# EAGLE schematic Resistor_Resistor (EAGLE 8.3.0), part 17 of 43
## Parts (continued)
R23018  10K  RESISTOR_0201  [0201]
R23019  10K  RESISTOR_0201  [0201]
R23020  10K  RESISTOR_0201  [0201]
R23021  10K  RESISTOR_0201  [0201]
R23022  10K  RESISTOR_0201  [0201]
R23023  10K  RESISTOR_0201  [0201]
R23024  10K  RESISTOR_0201  [0201]
R23025  10K  RESISTOR_0201  [0201]
R23026  10K  RESISTOR_0201  [0201]
R23027  10K  RESISTOR_0201  [0201]
R23028  10K  RESISTOR_0201  [0201]
R23029  10K  RESISTOR_0201  [0201]
R23030  10K  RESISTOR_0201  [0201]
R23031  10K  RESISTOR_0201  [0201]
R23032  10K  RESISTOR_0201  [0201]
R23033  10K  RESISTOR_0201  [0201]
R23034  10K  RESISTOR_0201  [0201]
R23035  10K  RESISTOR_0201  [0201]
R23036  10K  RESISTOR_0201  [0201]
R23037  10K  RESISTOR_0201  [0201]
R23038  10K  RESISTOR_0201  [0201]
R23039  10K  RESISTOR_0201  [0201]
R23040  10K  RESISTOR_0201  [0201]
R23041  10K  RESISTOR_0201  [0201]
R23042  10K  RESISTOR_0201  [0201]
R23043  10K  RESISTOR_0201  [0201]
R23044  10K  RESISTOR_0201  [0201]
R23045  10K  RESISTOR_0201  [0201]
R23046  10K  RESISTOR_0201  [0201]
R23047  10K  RESISTOR_0201  [0201]
R23048  10K  RESISTOR_0201  [0201]
R23049  10K  RESISTOR_0201  [0201]
R23050  10K  RESISTOR_0201  [0201]
R23051  10K  RESISTOR_0201  [0201]
R23052  10K  RESISTOR_0201  [0201]
R23053  10K  RESISTOR_0201  [0201]
R23054  10K  RESISTOR_0201  [0201]
R23055  10K  RESISTOR_0201  [0201]
R23056  10K  RESISTOR_0201  [0201]
R23057  10K  RESISTOR_0201  [0201]
R23058  10K  RESISTOR_0201  [0201]
R23059  10K  RESISTOR_0201  [0201]
R23060  10K  RESISTOR_0201  [0201]
R23061  10K  RESISTOR_0201  [0201]
R23062  10K  RESISTOR_0201  [0201]
R23063  10K  RESISTOR_0201  [0201]
R23064  10K  RESISTOR_0201  [0201]
R23065  10K  RESISTOR_0201  [0201]
R23066  10K  RESISTOR_0201  [0201]
R23067  10K  RESISTOR_0201  [0201]
R23068  10K  RESISTOR_0201  [0201]
R23069  10K  RESISTOR_0201  [0201]
R23070  10K  RESISTOR_0201  [0201]
R23071  10K  RESISTOR_0201  [0201]
R23072  10K  RESISTOR_0201  [0201]
R23073  10K  RESISTOR_0201  [0201]
R23074  10K  RESISTOR_0201  [0201]
R23075  10K  RESISTOR_0201  [0201]
R23076  10K  RESISTOR_0201  [0201]
R23077  10K  RESISTOR_0201  [0201]
R23078  10K  RESISTOR_0201  [0201]
R23079  10K  RESISTOR_0201  [0201]
R23080  10K  RESISTOR_0201  [0201]
R23081  10K  RESISTOR_0201  [0201]
R23082  10K  RESISTOR_0201  [0201]
R23083  10K  RESISTOR_0201  [0201]
R23084  10K  RESISTOR_0201  [0201]
R23085  10K  RESISTOR_0201  [0201]
R23086  10K  RESISTOR_0201  [0201]
R23087  10K  RESISTOR_0201  [0201]
R23088  10K  RESISTOR_0201  [0201]
R23089  10K  RESISTOR_0201  [0201]
R23090  10K  RESISTOR_0201  [0201]
R23091  10K  RESISTOR_0201  [0201]
R23092  10K  RESISTOR_0201  [0201]
R23093  10K  RESISTOR_0201  [0201]
R23094  10K  RESISTOR_0201  [0201]
R23095  10K  RESISTOR_0201  [0201]
R23096  10K  RESISTOR_0201  [0201]
R23097  10K  RESISTOR_0201  [0201]
R23098  10K  RESISTOR_0201  [0201]
R23099  10K  RESISTOR_0201  [0201]
R23100  10K  RESISTOR_0201  [0201]
R23101  10K  RESISTOR_0201  [0201]
R23102  10K  RESISTOR_0201  [0201]
R23103  10K  RESISTOR_0201  [0201]
R23104  10K  RESISTOR_0201  [0201]
R23105  10K  RESISTOR_0201  [0201]
R23106  10K  RESISTOR_0201  [0201]
R23107  10K  RESISTOR_0201  [0201]
R23108  10K  RESISTOR_0201  [0201]
R23109  10K  RESISTOR_0201  [0201]
R23110  10K  RESISTOR_0201  [0201]
R23111  10K  RESISTOR_0201  [0201]
R23112  10K  RESISTOR_0201  [0201]
R23113  10K  RESISTOR_0201  [0201]
R23114  10K  RESISTOR_0201  [0201]
R23115  10K  RESISTOR_0201  [0201]
R23116  10K  RESISTOR_0201  [0201]
R23117  10K  RESISTOR_0201  [0201]
R23118  10K  RESISTOR_0201  [0201]
R23119  10K  RESISTOR_0201  [0201]
R23120  10K  RESISTOR_0201  [0201]
R23121  10K  RESISTOR_0201  [0201]
R23122  10K  RESISTOR_0201  [0201]
R23123  10K  RESISTOR_0201  [0201]
R23124  10K  RESISTOR_0201  [0201]
R23125  10K  RESISTOR_0201  [0201]
R23126  10K  RESISTOR_0201  [0201]
R23127  10K  RESISTOR_0201  [0201]
R23128  10K  RESISTOR_0201  [0201]
R23129  10K  RESISTOR_0201  [0201]
R23130  10K  RESISTOR_0201  [0201]
R23131  10K  RESISTOR_0201  [0201]
R23132  10K  RESISTOR_0201  [0201]
R23133  10K  RESISTOR_0201  [0201]
R23134  10K  RESISTOR_0201  [0201]
R23135  10K  RESISTOR_0201  [0201]
R23136  10K  RESISTOR_0201  [0201]
R23137  10K  RESISTOR_0201  [0201]
R23138  10K  RESISTOR_0201  [0201]
R23139  10K  RESISTOR_0201  [0201]
R23140  10K  RESISTOR_0201  [0201]
R23141  10K  RESISTOR_0201  [0201]
R23142  10K  RESISTOR_0201  [0201]
R23143  10K  RESISTOR_0201  [0201]
R23144  10K  RESISTOR_0201  [0201]
R23145  10K  RESISTOR_0201  [0201]
R23146  10K  RESISTOR_0201  [0201]
R23147  10K  RESISTOR_0201  [0201]
R23148  10K  RESISTOR_0201  [0201]
R23149  10K  RESISTOR_0201  [0201]
R23150  10K  RESISTOR_0201  [0201]
R23151  10K  RESISTOR_0201  [0201]
R23152  10K  RESISTOR_0201  [0201]
R23153  10K  RESISTOR_0201  [0201]
R23154  10K  RESISTOR_0201  [0201]
R23155  10K  RESISTOR_0201  [0201]
R23156  10K  RESISTOR_0201  [0201]
R23157  10K  RESISTOR_0201  [0201]
R23158  10K  RESISTOR_0201  [0201]
R23159  10K  RESISTOR_0201  [0201]
R23160  10K  RESISTOR_0201  [0201]
R23161  10K  RESISTOR_0201  [0201]
R23162  10K  RESISTOR_0201  [0201]
R23163  10K  RESISTOR_0201  [0201]
R23164  10K  RESISTOR_0201  [0201]
R23165  10K  RESISTOR_0201  [0201]
R23166  10K  RESISTOR_0201  [0201]
R23167  10K  RESISTOR_0201  [0201]
R23168  10K  RESISTOR_0201  [0201]
R23169  10K  RESISTOR_0201  [0201]
R23170  10K  RESISTOR_0201  [0201]
R23171  10K  RESISTOR_0201  [0201]
R23172  10K  RESISTOR_0201  [0201]
R23173  10K  RESISTOR_0201  [0201]
R23174  10K  RESISTOR_0201  [0201]
R23175  10K  RESISTOR_0201  [0201]
R23176  10K  RESISTOR_0201  [0201]
R23177  10K  RESISTOR_0201  [0201]
R23178  10K  RESISTOR_0201  [0201]
R23179  10K  RESISTOR_0201  [0201]
R23180  10K  RESISTOR_0201  [0201]
R23181  10K  RESISTOR_0201  [0201]
R23182  10K  RESISTOR_0201  [0201]
R23183  10K  RESISTOR_0201  [0201]
R23184  10K  RESISTOR_0201  [0201]
R23185  10K  RESISTOR_0201  [0201]
R23186  10K  RESISTOR_0201  [0201]
R23187  10K  RESISTOR_0201  [0201]
R23188  10K  RESISTOR_0201  [0201]
R23189  10K  RESISTOR_0201  [0201]
R23190  10K  RESISTOR_0201  [0201]
R23191  10K  RESISTOR_0201  [0201]
R23192  10K  RESISTOR_0201  [0201]
R23193  10K  RESISTOR_0201  [0201]
R23194  10K  RESISTOR_0201  [0201]
R23195  10K  RESISTOR_0201  [0201]
R23196  10K  RESISTOR_0201  [0201]
R23197  10K  RESISTOR_0201  [0201]
R23198  10K  RESISTOR_0201  [0201]
R23199  10K  RESISTOR_0201  [0201]
R23200  10K  RESISTOR_0201  [0201]
R23201  10K  RESISTOR_0201  [0201]
R23202  10K  RESISTOR_0201  [0201]
R23203  10K  RESISTOR_0201  [0201]
R23204  10K  RESISTOR_0201  [0201]
R23205  10K  RESISTOR_0201  [0201]
R23206  10K  RESISTOR_0201  [0201]
R23207  10K  RESISTOR_0201  [0201]
R23208  10K  RESISTOR_0201  [0201]
R23209  10K  RESISTOR_0201  [0201]
R23210  10K  RESISTOR_0201  [0201]
R23211  10K  RESISTOR_0201  [0201]
R23212  10K  RESISTOR_0201  [0201]
R23213  10K  RESISTOR_0201  [0201]
R23214  10K  RESISTOR_0201  [0201]
R23215  10K  RESISTOR_0201  [0201]
R23216  10K  RESISTOR_0201  [0201]
R23217  10K  RESISTOR_0201  [0201]
R23218  10K  RESISTOR_0201  [0201]
R23219  10K  RESISTOR_0201  [0201]
R23220  10K  RESISTOR_0201  [0201]
R23221  10K  RESISTOR_0201  [0201]
R23222  10K  RESISTOR_0201  [0201]
R23223  10K  RESISTOR_0201  [0201]
R23224  10K  RESISTOR_0201  [0201]
R23225  10K  RESISTOR_0201  [0201]
R23226  10K  RESISTOR_0201  [0201]
R23227  10K  RESISTOR_0201  [0201]
R23228  10K  RESISTOR_0201  [0201]
R23229  10K  RESISTOR_0201  [0201]
R23230  10K  RESISTOR_0201  [0201]
R23231  10K  RESISTOR_0201  [0201]
R23232  10K  RESISTOR_0201  [0201]
R23233  10K  RESISTOR_0201  [0201]
R23234  10K  RESISTOR_0201  [0201]
R23235  10K  RESISTOR_0201  [0201]
R23236  10K  RESISTOR_0201  [0201]
R23237  10K  RESISTOR_0201  [0201]
R23238  10K  RESISTOR_0201  [0201]
R23239  10K  RESISTOR_0201  [0201]
R23240  10K  RESISTOR_0201  [0201]
R23241  10K  RESISTOR_0201  [0201]
R23242  10K  RESISTOR_0201  [0201]
R23243  10K  RESISTOR_0201  [0201]
R23244  10K  RESISTOR_0201  [0201]
R23245  10K  RESISTOR_0201  [0201]
R23246  10K  RESISTOR_0201  [0201]
R23247  10K  RESISTOR_0201  [0201]
R23248  10K  RESISTOR_0201  [0201]
R23249  10K  RESISTOR_0201  [0201]
R23250  10K  RESISTOR_0201  [0201]
R23251  10K  RESISTOR_0201  [0201]
R23252  10K  RESISTOR_0201  [0201]
R23253  10K  RESISTOR_0201  [0201]
R23254  10K  RESISTOR_0201  [0201]
R23255  10K  RESISTOR_0201  [0201]
R23256  10K  RESISTOR_0201  [0201]
R23257  10K  RESISTOR_0201  [0201]
R23258  10K  RESISTOR_0201  [0201]
R23259  10K  RESISTOR_0201  [0201]
R23260  10K  RESISTOR_0201  [0201]
R23261  10K  RESISTOR_0201  [0201]
R23262  10K  RESISTOR_0201  [0201]
R23263  10K  RESISTOR_0201  [0201]
R23264  10K  RESISTOR_0201  [0201]
R23265  10K  RESISTOR_0201  [0201]
R23266  10K  RESISTOR_0201  [0201]
R23267  10K  RESISTOR_0201  [0201]
R23268  10K  RESISTOR_0201  [0201]
R23269  10K  RESISTOR_0201  [0201]
R23270  10K  RESISTOR_0201  [0201]
R23271  10K  RESISTOR_0201  [0201]
R23272  10K  RESISTOR_0201  [0201]
R23273  10K  RESISTOR_0201  [0201]
R23274  10K  RESISTOR_0201  [0201]
R23275  10K  RESISTOR_0201  [0201]
R23276  10K  RESISTOR_0201  [0201]
R23277  10K  RESISTOR_0201  [0201]
R23278  10K  RESISTOR_0201  [0201]
R23279  10K  RESISTOR_0201  [0201]
R23280  10K  RESISTOR_0201  [0201]
R23281  10K  RESISTOR_0201  [0201]
R23282  10K  RESISTOR_0201  [0201]
R23283  10K  RESISTOR_0201  [0201]
R23284  10K  RESISTOR_0201  [0201]
R23285  10K  RESISTOR_0201  [0201]
R23286  10K  RESISTOR_0201  [0201]
R23287  10K  RESISTOR_0201  [0201]
R23288  10K  RESISTOR_0201  [0201]
R23289  10K  RESISTOR_0201  [0201]
R23290  10K  RESISTOR_0201  [0201]
R23291  10K  RESISTOR_0201  [0201]
R23292  10K  RESISTOR_0201  [0201]
R23293  10K  RESISTOR_0201  [0201]
R23294  10K  RESISTOR_0201  [0201]
R23295  10K  RESISTOR_0201  [0201]
R23296  10K  RESISTOR_0201  [0201]
R23297  10K  RESISTOR_0201  [0201]
R23298  10K  RESISTOR_0201  [0201]
R23299  10K  RESISTOR_0201  [0201]
R23300  10K  RESISTOR_0201  [0201]
R23301  10K  RESISTOR_0201  [0201]
R23302  10K  RESISTOR_0201  [0201]
R23303  10K  RESISTOR_0201  [0201]
R23304  10K  RESISTOR_0201  [0201]
R23305  10K  RESISTOR_0201  [0201]
R23306  10K  RESISTOR_0201  [0201]
R23307  10K  RESISTOR_0201  [0201]
R23308  10K  RESISTOR_0201  [0201]
R23309  10K  RESISTOR_0201  [0201]
R23310  10K  RESISTOR_0201  [0201]
R23311  10K  RESISTOR_0201  [0201]
R23312  10K  RESISTOR_0201  [0201]
R23313  10K  RESISTOR_0201  [0201]
R23314  10K  RESISTOR_0201  [0201]
R23315  10K  RESISTOR_0201  [0201]
R23316  10K  RESISTOR_0201  [0201]
R23317  10K  RESISTOR_0201  [0201]
R23318  10K  RESISTOR_0201  [0201]
R23319  10K  RESISTOR_0201  [0201]
R23320  10K  RESISTOR_0201  [0201]
R23321  10K  RESISTOR_0201  [0201]
R23322  10K  RESISTOR_0201  [0201]
R23323  10K  RESISTOR_0201  [0201]
R23324  10K  RESISTOR_0201  [0201]
R23325  10K  RESISTOR_0201  [0201]
R23326  10K  RESISTOR_0201  [0201]
R23327  10K  RESISTOR_0201  [0201]
R23328  10K  RESISTOR_0201  [0201]
R23329  10K  RESISTOR_0201  [0201]
R23330  10K  RESISTOR_0201  [0201]
R23331  10K  RESISTOR_0201  [0201]
R23332  10K  RESISTOR_0201  [0201]
R23333  10K  RESISTOR_0201  [0201]
R23334  10K  RESISTOR_0201  [0201]
R23335  10K  RESISTOR_0201  [0201]
R23336  10K  RESISTOR_0201  [0201]
R23337  10K  RESISTOR_0201  [0201]
R23338  10K  RESISTOR_0201  [0201]
R23339  10K  RESISTOR_0201  [0201]
R23340  10K  RESISTOR_0201  [0201]
R23341  10K  RESISTOR_0201  [0201]
R23342  10K  RESISTOR_0201  [0201]
R23343  10K  RESISTOR_0201  [0201]
R23344  10K  RESISTOR_0201  [0201]
R23345  10K  RESISTOR_0201  [0201]
R23346  10K  RESISTOR_0201  [0201]
R23347  10K  RESISTOR_0201  [0201]
R23348  10K  RESISTOR_0201  [0201]
R23349  10K  RESISTOR_0201  [0201]
R23350  10K  RESISTOR_0201  [0201]
R23351  10K  RESISTOR_0201  [0201]
R23352  10K  RESISTOR_0201  [0201]
R23353  10K  RESISTOR_0201  [0201]
R23354  10K  RESISTOR_0201  [0201]
R23355  10K  RESISTOR_0201  [0201]
R23356  10K  RESISTOR_0201  [0201]
R23357  10K  RESISTOR_0201  [0201]
R23358  10K  RESISTOR_0201  [0201]
R23359  10K  RESISTOR_0201  [0201]
R23360  10K  RESISTOR_0201  [0201]
R23361  10K  RESISTOR_0201  [0201]
R23362  10K  RESISTOR_0201  [0201]
R23363  10K  RESISTOR_0201  [0201]
R23364  10K  RESISTOR_0201  [0201]
R23365  10K  RESISTOR_0201  [0201]
R23366  10K  RESISTOR_0201  [0201]
R23367  10K  RESISTOR_0201  [0201]
R23368  10K  RESISTOR_0201  [0201]
R23369  10K  RESISTOR_0201  [0201]
R23370  10K  RESISTOR_0201  [0201]
R23371  10K  RESISTOR_0201  [0201]
R23372  10K  RESISTOR_0201  [0201]
R23373  10K  RESISTOR_0201  [0201]
R23374  10K  RESISTOR_0201  [0201]
R23375  10K  RESISTOR_0201  [0201]
R23376  10K  RESISTOR_0201  [0201]
R23377  10K  RESISTOR_0201  [0201]
R23378  10K  RESISTOR_0201  [0201]
R23379  10K  RESISTOR_0201  [0201]
R23380  10K  RESISTOR_0201  [0201]
R23381  10K  RESISTOR_0201  [0201]
R23382  10K  RESISTOR_0201  [0201]
R23383  10K  RESISTOR_0201  [0201]
R23384  10K  RESISTOR_0201  [0201]
R23385  10K  RESISTOR_0201  [0201]
R23386  10K  RESISTOR_0201  [0201]
R23387  10K  RESISTOR_0201  [0201]
R23388  10K  RESISTOR_0201  [0201]
R23389  10K  RESISTOR_0201  [0201]
R23390  10K  RESISTOR_0201  [0201]
R23391  10K  RESISTOR_0201  [0201]
R23392  10K  RESISTOR_0201  [0201]
R23393  10K  RESISTOR_0201  [0201]
R23394  10K  RESISTOR_0201  [0201]
R23395  10K  RESISTOR_0201  [0201]
R23396  10K  RESISTOR_0201  [0201]
R23397  10K  RESISTOR_0201  [0201]
R23398  10K  RESISTOR_0201  [0201]
R23399  10K  RESISTOR_0201  [0201]
R23400  10K  RESISTOR_0201  [0201]
R23401  10K  RESISTOR_0201  [0201]
R23402  10K  RESISTOR_0201  [0201]
R23403  10K  RESISTOR_0201  [0201]
R23404  10K  RESISTOR_0201  [0201]
R23405  10K  RESISTOR_0201  [0201]
R23406  10K  RESISTOR_0201  [0201]
R23407  10K  RESISTOR_0201  [0201]
R23408  10K  RESISTOR_0201  [0201]
R23409  10K  RESISTOR_0201  [0201]
R23410  10K  RESISTOR_0201  [0201]
R23411  10K  RESISTOR_0201  [0201]
R23412  10K  RESISTOR_0201  [0201]
R23413  10K  RESISTOR_0201  [0201]
R23414  10K  RESISTOR_0201  [0201]
R23415  10K  RESISTOR_0201  [0201]
R23416  10K  RESISTOR_0201  [0201]
R23417  10K  RESISTOR_0201  [0201]
R23418  10K  RESISTOR_0201  [0201]
R23419  10K  RESISTOR_0201  [0201]
R23420  10K  RESISTOR_0201  [0201]
R23421  10K  RESISTOR_0201  [0201]
R23422  10K  RESISTOR_0201  [0201]
R23423  10K  RESISTOR_0201  [0201]
R23424  10K  RESISTOR_0201  [0201]
R23425  10K  RESISTOR_0201  [0201]
R23426  10K  RESISTOR_0201  [0201]
R23427  10K  RESISTOR_0201  [0201]
R23428  10K  RESISTOR_0201  [0201]
R23429  10K  RESISTOR_0201  [0201]
R23430  10K  RESISTOR_0201  [0201]
R23431  10K  RESISTOR_0201  [0201]
R23432  10K  RESISTOR_0201  [0201]
R23433  10K  RESISTOR_0201  [0201]
R23434  10K  RESISTOR_0201  [0201]
R23435  10K  RESISTOR_0201  [0201]
R23436  10K  RESISTOR_0201  [0201]
R23437  10K  RESISTOR_0201  [0201]
R23438  10K  RESISTOR_0201  [0201]
R23439  10K  RESISTOR_0201  [0201]
R23440  10K  RESISTOR_0201  [0201]
R23441  10K  RESISTOR_0201  [0201]
R23442  10K  RESISTOR_0201  [0201]
R23443  10K  RESISTOR_0201  [0201]
R23444  10K  RESISTOR_0201  [0201]
R23445  10K  RESISTOR_0201  [0201]
R23446  10K  RESISTOR_0201  [0201]
R23447  10K  RESISTOR_0201  [0201]
R23448  10K  RESISTOR_0201  [0201]
R23449  10K  RESISTOR_0201  [0201]
R23450  10K  RESISTOR_0201  [0201]
R23451  10K  RESISTOR_0201  [0201]
R23452  10K  RESISTOR_0201  [0201]
R23453  10K  RESISTOR_0201  [0201]
R23454  10K  RESISTOR_0201  [0201]
R23455  10K  RESISTOR_0201  [0201]
R23456  10K  RESISTOR_0201  [0201]
R23457  10K  RESISTOR_0201  [0201]
R23458  10K  RESISTOR_0201  [0201]
R23459  10K  RESISTOR_0201  [0201]
R23460  10K  RESISTOR_0201  [0201]
R23461  10K  RESISTOR_0201  [0201]
R23462  10K  RESISTOR_0201  [0201]
R23463  10K  RESISTOR_0201  [0201]
R23464  10K  RESISTOR_0201  [0201]
R23465  10K  RESISTOR_0201  [0201]
R23466  10K  RESISTOR_0201  [0201]
R23467  10K  RESISTOR_0201  [0201]
R23468  10K  RESISTOR_0201  [0201]
R23469  10K  RESISTOR_0201  [0201]
R23470  10K  RESISTOR_0201  [0201]
R23471  10K  RESISTOR_0201  [0201]
R23472  10K  RESISTOR_0201  [0201]
R23473  10K  RESISTOR_0201  [0201]
R23474  10K  RESISTOR_0201  [0201]
R23475  10K  RESISTOR_0201  [0201]
R23476  10K  RESISTOR_0201  [0201]
R23477  10K  RESISTOR_0201  [0201]
R23478  10K  RESISTOR_0201  [0201]
R23479  10K  RESISTOR_0201  [0201]
R23480  10K  RESISTOR_0201  [0201]
R23481  10K  RESISTOR_0201  [0201]
R23482  10K  RESISTOR_0201  [0201]
R23483  10K  RESISTOR_0201  [0201]
R23484  10K  RESISTOR_0201  [0201]
R23485  10K  RESISTOR_0201  [0201]
R23486  10K  RESISTOR_0201  [0201]
R23487  10K  RESISTOR_0201  [0201]
R23488  10K  RESISTOR_0201  [0201]
R23489  10K  RESISTOR_0201  [0201]
R23490  10K  RESISTOR_0201  [0201]
R23491  10K  RESISTOR_0201  [0201]
R23492  10K  RESISTOR_0201  [0201]
R23493  10K  RESISTOR_0201  [0201]
R23494  10K  RESISTOR_0201  [0201]
R23495  10K  RESISTOR_0201  [0201]
R23496  10K  RESISTOR_0201  [0201]
R23497  10K  RESISTOR_0201  [0201]
R23498  10K  RESISTOR_0201  [0201]
R23499  10K  RESISTOR_0201  [0201]
R23500  10K  RESISTOR_0201  [0201]
R23501  10K  RESISTOR_0201  [0201]
R23502  10K  RESISTOR_0201  [0201]
R23503  10K  RESISTOR_0201  [0201]
R23504  10K  RESISTOR_0201  [0201]
R23505  10K  RESISTOR_0201  [0201]
R23506  10K  RESISTOR_0201  [0201]
R23507  10K  RESISTOR_0201  [0201]
R23508  10K  RESISTOR_0201  [0201]
R23509  10K  RESISTOR_0201  [0201]
R23510  10K  RESISTOR_0201  [0201]
R23511  10K  RESISTOR_0201  [0201]
R23512  10K  RESISTOR_0201  [0201]
R23513  10K  RESISTOR_0201  [0201]
R23514  10K  RESISTOR_0201  [0201]
R23515  10K  RESISTOR_0201  [0201]
R23516  10K  RESISTOR_0201  [0201]
R23517  10K  RESISTOR_0201  [0201]
R23518  10K  RESISTOR_0201  [0201]
R23519  10K  RESISTOR_0201  [0201]
R23520  10K  RESISTOR_0201  [0201]
R23521  10K  RESISTOR_0201  [0201]
R23522  10K  RESISTOR_0201  [0201]
R23523  10K  RESISTOR_0201  [0201]
R23524  10K  RESISTOR_0201  [0201]
R23525  10K  RESISTOR_0201  [0201]
R23526  10K  RESISTOR_0201  [0201]
R23527  10K  RESISTOR_0201  [0201]
R23528  10K  RESISTOR_0201  [0201]
R23529  10K  RESISTOR_0201  [0201]
R23530  10K  RESISTOR_0201  [0201]
R23531  10K  RESISTOR_0201  [0201]
R23532  10K  RESISTOR_0201  [0201]
R23533  10K  RESISTOR_0201  [0201]
R23534  10K  RESISTOR_0201  [0201]
R23535  10K  RESISTOR_0201  [0201]
R23536  10K  RESISTOR_0201  [0201]
R23537  10K  RESISTOR_0201  [0201]
R23538  10K  RESISTOR_0201  [0201]
R23539  10K  RESISTOR_0201  [0201]
R23540  10K  RESISTOR_0201  [0201]
R23541  10K  RESISTOR_0201  [0201]
R23542  10K  RESISTOR_0201  [0201]
R23543  10K  RESISTOR_0201  [0201]
R23544  10K  RESISTOR_0201  [0201]
R23545  10K  RESISTOR_0201  [0201]
R23546  10K  RESISTOR_0201  [0201]
R23547  10K  RESISTOR_0201  [0201]
R23548  10K  RESISTOR_0201  [0201]
R23549  10K  RESISTOR_0201  [0201]
R23550  10K  RESISTOR_0201  [0201]
R23551  10K  RESISTOR_0201  [0201]
R23552  10K  RESISTOR_0201  [0201]
R23553  10K  RESISTOR_0201  [0201]
R23554  10K  RESISTOR_0201  [0201]
R23555  10K  RESISTOR_0201  [0201]
R23556  10K  RESISTOR_0201  [0201]
R23557  10K  RESISTOR_0201  [0201]
R23558  10K  RESISTOR_0201  [0201]
R23559  10K  RESISTOR_0201  [0201]
R23560  10K  RESISTOR_0201  [0201]
R23561  10K  RESISTOR_0201  [0201]
R23562  10K  RESISTOR_0201  [0201]
R23563  10K  RESISTOR_0201  [0201]
R23564  10K  RESISTOR_0201  [0201]
R23565  10K  RESISTOR_0201  [0201]
R23566  10K  RESISTOR_0201  [0201]
R23567  10K  RESISTOR_0201  [0201]
R23568  10K  RESISTOR_0201  [0201]
R23569  10K  RESISTOR_0201  [0201]
R23570  10K  RESISTOR_0201  [0201]
R23571  10K  RESISTOR_0201  [0201]
R23572  10K  RESISTOR_0201  [0201]
R23573  10K  RESISTOR_0201  [0201]
R23574  10K  RESISTOR_0201  [0201]
R23575  10K  RESISTOR_0201  [0201]
R23576  10K  RESISTOR_0201  [0201]
R23577  10K  RESISTOR_0201  [0201]
R23578  10K  RESISTOR_0201  [0201]
R23579  10K  RESISTOR_0201  [0201]
R23580  10K  RESISTOR_0201  [0201]
R23581  10K  RESISTOR_0201  [0201]
R23582  10K  RESISTOR_0201  [0201]
R23583  10K  RESISTOR_0201  [0201]
R23584  10K  RESISTOR_0201  [0201]
R23585  10K  RESISTOR_0201  [0201]
R23586  10K  RESISTOR_0201  [0201]
R23587  10K  RESISTOR_0201  [0201]
R23588  10K  RESISTOR_0201  [0201]
R23589  10K  RESISTOR_0201  [0201]
R23590  10K  RESISTOR_0201  [0201]
R23591  10K  RESISTOR_0201  [0201]
R23592  10K  RESISTOR_0201  [0201]
R23593  10K  RESISTOR_0201  [0201]
R23594  10K  RESISTOR_0201  [0201]
R23595  10K  RESISTOR_0201  [0201]
R23596  10K  RESISTOR_0201  [0201]
R23597  10K  RESISTOR_0201  [0201]
R23598  10K  RESISTOR_0201  [0201]
R23599  10K  RESISTOR_0201  [0201]
R23600  10K  RESISTOR_0201  [0201]
R23601  10K  RESISTOR_0201  [0201]
R23602  10K  RESISTOR_0201  [0201]
R23603  10K  RESISTOR_0201  [0201]
R23604  10K  RESISTOR_0201  [0201]
R23605  10K  RESISTOR_0201  [0201]
R23606  10K  RESISTOR_0201  [0201]
R23607  10K  RESISTOR_0201  [0201]
R23608  10K  RESISTOR_0201  [0201]
R23609  10K  RESISTOR_0201  [0201]
R23610  10K  RESISTOR_0201  [0201]
R23611  10K  RESISTOR_0201  [0201]
R23612  10K  RESISTOR_0201  [0201]
R23613  10K  RESISTOR_0201  [0201]
R23614  10K  RESISTOR_0201  [0201]
R23615  10K  RESISTOR_0201  [0201]
R23616  10K  RESISTOR_0201  [0201]
R23617  10K  RESISTOR_0201  [0201]
R23618  10K  RESISTOR_0201  [0201]
R23619  10K  RESISTOR_0201  [0201]
R23620  10K  RESISTOR_0201  [0201]
R23621  10K  RESISTOR_0201  [0201]
R23622  10K  RESISTOR_0201  [0201]
R23623  10K  RESISTOR_0201  [0201]
R23624  10K  RESISTOR_0201  [0201]
R23625  10K  RESISTOR_0201  [0201]
R23626  10K  RESISTOR_0201  [0201]
R23627  10K  RESISTOR_0201  [0201]
R23628  10K  RESISTOR_0201  [0201]
R23629  10K  RESISTOR_0201  [0201]
R23630  10K  RESISTOR_0201  [0201]
R23631  10K  RESISTOR_0201  [0201]
R23632  10K  RESISTOR_0201  [0201]
R23633  10K  RESISTOR_0201  [0201]
R23634  10K  RESISTOR_0201  [0201]
R23635  10K  RESISTOR_0201  [0201]
R23636  10K  RESISTOR_0201  [0201]
R23637  10K  RESISTOR_0201  [0201]
R23638  10K  RESISTOR_0201  [0201]
R23639  10K  RESISTOR_0201  [0201]
R23640  10K  RESISTOR_0201  [0201]
R23641  10K  RESISTOR_0201  [0201]
R23642  10K  RESISTOR_0201  [0201]
R23643  10K  RESISTOR_0201  [0201]
R23644  10K  RESISTOR_0201  [0201]
R23645  10K  RESISTOR_0201  [0201]
R23646  10K  RESISTOR_0201  [0201]
R23647  10K  RESISTOR_0201  [0201]
R23648  10K  RESISTOR_0201  [0201]
R23649  10K  RESISTOR_0201  [0201]
R23650  10K  RESISTOR_0201  [0201]
R23651  10K  RESISTOR_0201  [0201]
R23652  10K  RESISTOR_0201  [0201]
R23653  10K  RESISTOR_0201  [0201]
R23654  10K  RESISTOR_0201  [0201]
R23655  10K  RESISTOR_0201  [0201]
R23656  10K  RESISTOR_0201  [0201]
R23657  10K  RESISTOR_0201  [0201]
R23658  10K  RESISTOR_0201  [0201]
R23659  10K  RESISTOR_0201  [0201]
R23660  10K  RESISTOR_0201  [0201]
R23661  10K  RESISTOR_0201  [0201]
R23662  10K  RESISTOR_0201  [0201]
R23663  10K  RESISTOR_0201  [0201]
R23664  10K  RESISTOR_0201  [0201]
R23665  10K  RESISTOR_0201  [0201]
R23666  10K  RESISTOR_0201  [0201]
R23667  10K  RESISTOR_0201  [0201]
R23668  10K  RESISTOR_0201  [0201]
R23669  10K  RESISTOR_0201  [0201]
R23670  10K  RESISTOR_0201  [0201]
R23671  10K  RESISTOR_0201  [0201]
R23672  10K  RESISTOR_0201  [0201]
R23673  10K  RESISTOR_0201  [0201]
R23674  10K  RESISTOR_0201  [0201]
R23675  10K  RESISTOR_0201  [0201]
R23676  10K  RESISTOR_0201  [0201]
R23677  10K  RESISTOR_0201  [0201]
R23678  10K  RESISTOR_0201  [0201]
R23679  10K  RESISTOR_0201  [0201]
R23680  10K  RESISTOR_0201  [0201]
R23681  10K  RESISTOR_0201  [0201]
R23682  10K  RESISTOR_0201  [0201]
R23683  10K  RESISTOR_0201  [0201]
R23684  10K  RESISTOR_0201  [0201]
R23685  10K  RESISTOR_0201  [0201]
R23686  10K  RESISTOR_0201  [0201]
R23687  10K  RESISTOR_0201  [0201]
R23688  10K  RESISTOR_0201  [0201]
R23689  10K  RESISTOR_0201  [0201]
R23690  10K  RESISTOR_0201  [0201]
R23691  10K  RESISTOR_0201  [0201]
R23692  10K  RESISTOR_0201  [0201]
R23693  10K  RESISTOR_0201  [0201]
R23694  10K  RESISTOR_0201  [0201]
R23695  10K  RESISTOR_0201  [0201]
R23696  10K  RESISTOR_0201  [0201]
R23697  10K  RESISTOR_0201  [0201]
R23698  10K  RESISTOR_0201  [0201]
R23699  10K  RESISTOR_0201  [0201]
R23700  10K  RESISTOR_0201  [0201]
R23701  10K  RESISTOR_0201  [0201]
R23702  10K  RESISTOR_0201  [0201]
R23703  10K  RESISTOR_0201  [0201]
R23704  10K  RESISTOR_0201  [0201]
R23705  10K  RESISTOR_0201  [0201]
R23706  10K  RESISTOR_0201  [0201]
R23707  10K  RESISTOR_0201  [0201]
R23708  10K  RESISTOR_0201  [0201]
R23709  10K  RESISTOR_0201  [0201]
R23710  10K  RESISTOR_0201  [0201]
R23711  10K  RESISTOR_0201  [0201]
R23712  10K  RESISTOR_0201  [0201]
R23713  10K  RESISTOR_0201  [0201]
R23714  10K  RESISTOR_0201  [0201]
R23715  10K  RESISTOR_0201  [0201]
R23716  10K  RESISTOR_0201  [0201]
R23717  10K  RESISTOR_0201  [0201]
R23718  10K  RESISTOR_0201  [0201]
R23719  10K  RESISTOR_0201  [0201]
R23720  10K  RESISTOR_0201  [0201]
R23721  10K  RESISTOR_0201  [0201]
R23722  10K  RESISTOR_0201  [0201]
R23723  10K  RESISTOR_0201  [0201]
R23724  10K  RESISTOR_0201  [0201]
R23725  10K  RESISTOR_0201  [0201]
R23726  10K  RESISTOR_0201  [0201]
R23727  10K  RESISTOR_0201  [0201]
R23728  10K  RESISTOR_0201  [0201]
R23729  10K  RESISTOR_0201  [0201]
R23730  10K  RESISTOR_0201  [0201]
R23731  10K  RESISTOR_0201  [0201]
R23732  10K  RESISTOR_0201  [0201]
R23733  10K  RESISTOR_0201  [0201]
R23734  10K  RESISTOR_0201  [0201]
R23735  10K  RESISTOR_0201  [0201]
R23736  10K  RESISTOR_0201  [0201]
R23737  10K  RESISTOR_0201  [0201]
R23738  10K  RESISTOR_0201  [0201]
R23739  10K  RESISTOR_0201  [0201]
R23740  10K  RESISTOR_0201  [0201]
R23741  10K  RESISTOR_0201  [0201]
R23742  10K  RESISTOR_0201  [0201]
R23743  10K  RESISTOR_0201  [0201]
R23744  10K  RESISTOR_0201  [0201]
R23745  10K  RESISTOR_0201  [0201]
R23746  10K  RESISTOR_0201  [0201]
R23747  10K  RESISTOR_0201  [0201]
R23748  10K  RESISTOR_0201  [0201]
R23749  10K  RESISTOR_0201  [0201]
R23750  10K  RESISTOR_0201  [0201]
R23751  10K  RESISTOR_0201  [0201]
R23752  10K  RESISTOR_0201  [0201]
R23753  10K  RESISTOR_0201  [0201]
R23754  10K  RESISTOR_0201  [0201]
R23755  10K  RESISTOR_0201  [0201]
R23756  10K  RESISTOR_0201  [0201]
R23757  10K  RESISTOR_0201  [0201]
R23758  10K  RESISTOR_0201  [0201]
R23759  10K  RESISTOR_0201  [0201]
R23760  10K  RESISTOR_0201  [0201]
R23761  10K  RESISTOR_0201  [0201]
R23762  10K  RESISTOR_0201  [0201]
R23763  10K  RESISTOR_0201  [0201]
R23764  10K  RESISTOR_0201  [0201]
R23765  10K  RESISTOR_0201  [0201]
R23766  10K  RESISTOR_0201  [0201]
R23767  10K  RESISTOR_0201  [0201]
R23768  10K  RESISTOR_0201  [0201]
R23769  10K  RESISTOR_0201  [0201]
R23770  10K  RESISTOR_0201  [0201]
R23771  10K  RESISTOR_0201  [0201]
R23772  10K  RESISTOR_0201  [0201]
R23773  10K  RESISTOR_0201  [0201]
R23774  10K  RESISTOR_0201  [0201]
R23775  10K  RESISTOR_0201  [0201]
R23776  10K  RESISTOR_0201  [0201]
R23777  10K  RESISTOR_0201  [0201]
R23778  10K  RESISTOR_0201  [0201]
R23779  10K  RESISTOR_0201  [0201]
R23780  10K  RESISTOR_0201  [0201]
R23781  10K  RESISTOR_0201  [0201]
R23782  10K  RESISTOR_0201  [0201]
R23783  10K  RESISTOR_0201  [0201]
R23784  10K  RESISTOR_0201  [0201]
R23785  10K  RESISTOR_0201  [0201]
R23786  10K  RESISTOR_0201  [0201]
R23787  10K  RESISTOR_0201  [0201]
R23788  10K  RESISTOR_0201  [0201]
R23789  10K  RESISTOR_0201  [0201]
R23790  10K  RESISTOR_0201  [0201]
R23791  10K  RESISTOR_0201  [0201]
R23792  10K  RESISTOR_0201  [0201]
R23793  10K  RESISTOR_0201  [0201]
R23794  10K  RESISTOR_0201  [0201]
R23795  10K  RESISTOR_0201  [0201]
R23796  10K  RESISTOR_0201  [0201]
R23797  10K  RESISTOR_0201  [0201]
R23798  10K  RESISTOR_0201  [0201]
R23799  10K  RESISTOR_0201  [0201]
R23800  10K  RESISTOR_0201  [0201]
R23801  10K  RESISTOR_0201  [0201]
R23802  10K  RESISTOR_0201  [0201]
R23803  10K  RESISTOR_0201  [0201]
R23804  10K  RESISTOR_0201  [0201]
R23805  10K  RESISTOR_0201  [0201]
R23806  10K  RESISTOR_0201  [0201]
R23807  10K  RESISTOR_0201  [0201]
R23808  10K  RESISTOR_0201  [0201]
R23809  10K  RESISTOR_0201  [0201]
R23810  10K  RESISTOR_0201  [0201]
R23811  10K  RESISTOR_0201  [0201]
R23812  10K  RESISTOR_0201  [0201]
R23813  10K  RESISTOR_0201  [0201]
R23814  10K  RESISTOR_0201  [0201]
R23815  10K  RESISTOR_0201  [0201]
R23816  10K  RESISTOR_0201  [0201]
R23817  10K  RESISTOR_0201  [0201]
R23818  10K  RESISTOR_0201  [0201]
R23819  10K  RESISTOR_0201  [0201]
R23820  10K  RESISTOR_0201  [0201]
R23821  10K  RESISTOR_0201  [0201]
R23822  10K  RESISTOR_0201  [0201]
R23823  10K  RESISTOR_0201  [0201]
R23824  10K  RESISTOR_0201  [0201]
R23825  10K  RESISTOR_0201  [0201]
R23826  10K  RESISTOR_0201  [0201]
R23827  10K  RESISTOR_0201  [0201]
R23828  10K  RESISTOR_0201  [0201]
R23829  10K  RESISTOR_0201  [0201]
R23830  10K  RESISTOR_0201  [0201]
R23831  10K  RESISTOR_0201  [0201]
R23832  10K  RESISTOR_0201  [0201]
R23833  10K  RESISTOR_0201  [0201]
R23834  10K  RESISTOR_0201  [0201]
R23835  10K  RESISTOR_0201  [0201]
R23836  10K  RESISTOR_0201  [0201]
R23837  10K  RESISTOR_0201  [0201]
R23838  10K  RESISTOR_0201  [0201]
R23839  10K  RESISTOR_0201  [0201]
R23840  10K  RESISTOR_0201  [0201]
R23841  10K  RESISTOR_0201  [0201]
R23842  10K  RESISTOR_0201  [0201]
R23843  10K  RESISTOR_0201  [0201]
R23844  10K  RESISTOR_0201  [0201]
R23845  10K  RESISTOR_0201  [0201]
R23846  10K  RESISTOR_0201  [0201]
R23847  10K  RESISTOR_0201  [0201]
R23848  10K  RESISTOR_0201  [0201]
R23849  10K  RESISTOR_0201  [0201]
R23850  10K  RESISTOR_0201  [0201]
R23851  10K  RESISTOR_0201  [0201]
R23852  10K  RESISTOR_0201  [0201]
R23853  10K  RESISTOR_0201  [0201]
R23854  10K  RESISTOR_0201  [0201]
R23855  10K  RESISTOR_0201  [0201]
R23856  10K  RESISTOR_0201  [0201]
R23857  10K  RESISTOR_0201  [0201]
R23858  10K  RESISTOR_0201  [0201]
R23859  10K  RESISTOR_0201  [0201]
R23860  10K  RESISTOR_0201  [0201]
R23861  10K  RESISTOR_0201  [0201]
R23862  10K  RESISTOR_0201  [0201]
R23863  10K  RESISTOR_0201  [0201]
R23864  10K  RESISTOR_0201  [0201]
R23865  10K  RESISTOR_0201  [0201]
R23866  10K  RESISTOR_0201  [0201]
R23867  10K  RESISTOR_0201  [0201]
R23868  10K  RESISTOR_0201  [0201]
R23869  10K  RESISTOR_0201  [0201]
R23870  10K  RESISTOR_0201  [0201]
R23871  10K  RESISTOR_0201  [0201]
R23872  10K  RESISTOR_0201  [0201]
R23873  10K  RESISTOR_0201  [0201]
R23874  10K  RESISTOR_0201  [0201]
R23875  10K  RESISTOR_0201  [0201]
R23876  10K  RESISTOR_0201  [0201]
R23877  10K  RESISTOR_0201  [0201]
R23878  10K  RESISTOR_0201  [0201]
R23879  10K  RESISTOR_0201  [0201]
R23880  10K  RESISTOR_0201  [0201]
R23881  10K  RESISTOR_0201  [0201]
R23882  10K  RESISTOR_0201  [0201]
R23883  10K  RESISTOR_0201  [0201]
R23884  10K  RESISTOR_0201  [0201]
R23885  10K  RESISTOR_0201  [0201]
R23886  10K  RESISTOR_0201  [0201]
R23887  10K  RESISTOR_0201  [0201]
R23888  10K  RESISTOR_0201  [0201]
R23889  10K  RESISTOR_0201  [0201]
R23890  10K  RESISTOR_0201  [0201]
R23891  10K  RESISTOR_0201  [0201]
R23892  10K  RESISTOR_0201  [0201]
R23893  10K  RESISTOR_0201  [0201]
R23894  10K  RESISTOR_0201  [0201]
R23895  10K  RESISTOR_0201  [0201]
R23896  10K  RESISTOR_0201  [0201]
R23897  10K  RESISTOR_0201  [0201]
R23898  10K  RESISTOR_0201  [0201]
R23899  10K  RESISTOR_0201  [0201]
R23900  10K  RESISTOR_0201  [0201]
R23901  10K  RESISTOR_0201  [0201]
R23902  10K  RESISTOR_0201  [0201]
R23903  10K  RESISTOR_0201  [0201]
R23904  10K  RESISTOR_0201  [0201]
R23905  10K  RESISTOR_0201  [0201]
R23906  10K  RESISTOR_0201  [0201]
R23907  10K  RESISTOR_0201  [0201]
R23908  10K  RESISTOR_0201  [0201]
R23909  10K  RESISTOR_0201  [0201]
R23910  10K  RESISTOR_0201  [0201]
R23911  10K  RESISTOR_0201  [0201]
R23912  10K  RESISTOR_0201  [0201]
R23913  10K  RESISTOR_0201  [0201]
R23914  10K  RESISTOR_0201  [0201]
R23915  10K  RESISTOR_0201  [0201]
R23916  10K  RESISTOR_0201  [0201]
R23917  10K  RESISTOR_0201  [0201]
R23918  10K  RESISTOR_0201  [0201]
R23919  10K  RESISTOR_0201  [0201]
R23920  10K  RESISTOR_0201  [0201]
R23921  10K  RESISTOR_0201  [0201]
R23922  10K  RESISTOR_0201  [0201]
R23923  10K  RESISTOR_0201  [0201]
R23924  10K  RESISTOR_0201  [0201]
R23925  10K  RESISTOR_0201  [0201]
R23926  10K  RESISTOR_0201  [0201]
R23927  10K  RESISTOR_0201  [0201]
R23928  10K  RESISTOR_0201  [0201]
R23929  10K  RESISTOR_0201  [0201]
R23930  10K  RESISTOR_0201  [0201]
R23931  10K  RESISTOR_0201  [0201]
R23932  10K  RESISTOR_0201  [0201]
R23933  10K  RESISTOR_0201  [0201]
R23934  10K  RESISTOR_0201  [0201]
R23935  10K  RESISTOR_0201  [0201]
R23936  10K  RESISTOR_0201  [0201]
R23937  10K  RESISTOR_0201  [0201]
R23938  10K  RESISTOR_0201  [0201]
R23939  10K  RESISTOR_0201  [0201]
R23940  10K  RESISTOR_0201  [0201]
R23941  10K  RESISTOR_0201  [0201]
R23942  10K  RESISTOR_0201  [0201]
R23943  10K  RESISTOR_0201  [0201]
R23944  10K  RESISTOR_0201  [0201]
R23945  10K  RESISTOR_0201  [0201]
R23946  10K  RESISTOR_0201  [0201]
R23947  10K  RESISTOR_0201  [0201]
R23948  10K  RESISTOR_0201  [0201]
R23949  10K  RESISTOR_0201  [0201]
R23950  10K  RESISTOR_0201  [0201]
R23951  10K  RESISTOR_0201  [0201]
R23952  10K  RESISTOR_0201  [0201]
R23953  10K  RESISTOR_0201  [0201]
R23954  10K  RESISTOR_0201  [0201]
R23955  10K  RESISTOR_0201  [0201]
R23956  10K  RESISTOR_0201  [0201]
R23957  10K  RESISTOR_0201  [0201]
R23958  10K  RESISTOR_0201  [0201]
R23959  10K  RESISTOR_0201  [0201]
R23960  10K  RESISTOR_0201  [0201]
R23961  10K  RESISTOR_0201  [0201]
R23962  10K  RESISTOR_0201  [0201]
R23963  10K  RESISTOR_0201  [0201]
R23964  10K  RESISTOR_0201  [0201]
R23965  10K  RESISTOR_0201  [0201]
R23966  10K  RESISTOR_0201  [0201]
R23967  10K  RESISTOR_0201  [0201]
R23968  10K  RESISTOR_0201  [0201]
R23969  10K  RESISTOR_0201  [0201]
R23970  10K  RESISTOR_0201  [0201]
R23971  10K  RESISTOR_0201  [0201]
R23972  10K  RESISTOR_0201  [0201]
R23973  10K  RESISTOR_0201  [0201]
R23974  10K  RESISTOR_0201  [0201]
R23975  10K  RESISTOR_0201  [0201]
R23976  10K  RESISTOR_0201  [0201]
R23977  10K  RESISTOR_0201  [0201]
R23978  10K  RESISTOR_0201  [0201]
R23979  10K  RESISTOR_0201  [0201]
R23980  10K  RESISTOR_0201  [0201]
R23981  10K  RESISTOR_0201  [0201]
R23982  10K  RESISTOR_0201  [0201]
R23983  10K  RESISTOR_0201  [0201]
R23984  10K  RESISTOR_0201  [0201]
R23985  10K  RESISTOR_0201  [0201]
R23986  10K  RESISTOR_0201  [0201]
R23987  10K  RESISTOR_0201  [0201]
R23988  10K  RESISTOR_0201  [0201]
R23989  10K  RESISTOR_0201  [0201]
R23990  10K  RESISTOR_0201  [0201]
R23991  10K  RESISTOR_0201  [0201]
R23992  10K  RESISTOR_0201  [0201]
R23993  10K  RESISTOR_0201  [0201]
R23994  10K  RESISTOR_0201  [0201]
R23995  10K  RESISTOR_0201  [0201]
R23996  10K  RESISTOR_0201  [0201]
R23997  10K  RESISTOR_0201  [0201]
R23998  10K  RESISTOR_0201  [0201]
R23999  10K  RESISTOR_0201  [0201]
R24000  10K  RESISTOR_0201  [0201]
R24001  10K  RESISTOR_0201  [0201]
R24002  10K  RESISTOR_0201  [0201]
R24003  10K  RESISTOR_0201  [0201]
R24004  10K  RESISTOR_0201  [0201]
R24005  10K  RESISTOR_0201  [0201]
R24006  10K  RESISTOR_0201  [0201]
R24007  10K  RESISTOR_0201  [0201]
R24008  10K  RESISTOR_0201  [0201]
R24009  10K  RESISTOR_0201  [0201]
R24010  10K  RESISTOR_0201  [0201]
R24011  10K  RESISTOR_0201  [0201]
R24012  10K  RESISTOR_0201  [0201]
R24013  10K  RESISTOR_0201  [0201]
R24014  10K  RESISTOR_0201  [0201]
R24015  10K  RESISTOR_0201  [0201]
R24016  10K  RESISTOR_0201  [0201]
R24017  10K  RESISTOR_0201  [0201]
R24018  10K  RESISTOR_0201  [0201]
R24019  10K  RESISTOR_0201  [0201]
R24020  10K  RESISTOR_0201  [0201]
R24021  10K  RESISTOR_0201  [0201]
R24022  10K  RESISTOR_0201  [0201]
R24023  10K  RESISTOR_0201  [0201]
R24024  10K  RESISTOR_0201  [0201]
R24025  10K  RESISTOR_0201  [0201]
R24026  10K  RESISTOR_0201  [0201]
R24027  10K  RESISTOR_0201  [0201]
R24028  10K  RESISTOR_0201  [0201]
R24029  10K  RESISTOR_0201  [0201]
R24030  10K  RESISTOR_0201  [0201]
R24031  10K  RESISTOR_0201  [0201]
R24032  10K  RESISTOR_0201  [0201]
R24033  10K  RESISTOR_0201  [0201]
R24034  10K  RESISTOR_0201  [0201]
R24035  10K  RESISTOR_0201  [0201]
R24036  10K  RESISTOR_0201  [0201]
R24037  10K  RESISTOR_0201  [0201]
R24038  10K  RESISTOR_0201  [0201]
R24039  10K  RESISTOR_0201  [0201]
R24040  10K  RESISTOR_0201  [0201]
R24041  10K  RESISTOR_0201  [0201]
R24042  10K  RESISTOR_0201  [0201]
R24043  10K  RESISTOR_0201  [0201]
R24044  10K  RESISTOR_0201  [0201]
R24045  10K  RESISTOR_0201  [0201]
R24046  10K  RESISTOR_0201  [0201]
R24047  10K  RESISTOR_0201  [0201]
R24048  10K  RESISTOR_0201  [0201]
R24049  10K  RESISTOR_0201  [0201]
R24050  10K  RESISTOR_0201  [0201]
R24051  10K  RESISTOR_0201  [0201]
R24052  10K  RESISTOR_0201  [0201]
R24053  10K  RESISTOR_0201  [0201]
R24054  10K  RESISTOR_0201  [0201]
R24055  10K  RESISTOR_0201  [0201]
R24056  10K  RESISTOR_0201  [0201]
R24057  10K  RESISTOR_0201  [0201]
R24058  10K  RESISTOR_0201  [0201]
R24059  10K  RESISTOR_0201  [0201]
R24060  10K  RESISTOR_0201  [0201]
R24061  10K  RESISTOR_0201  [0201]
R24062  10K  RESISTOR_0201  [0201]
R24063  10K  RESISTOR_0201  [0201]
R24064  10K  RESISTOR_0201  [0201]
R24065  10K  RESISTOR_0201  [0201]
R24066  10K  RESISTOR_0201  [0201]
R24067  10K  RESISTOR_0201  [0201]
R24068  10K  RESISTOR_0201  [0201]
R24069  10K  RESISTOR_0201  [0201]
R24070  10K  RESISTOR_0201  [0201]
R24071  10K  RESISTOR_0201  [0201]
R24072  10K  RESISTOR_0201  [0201]
R24073  10K  RESISTOR_0201  [0201]
R24074  10K  RESISTOR_0201  [0201]
R24075  10K  RESISTOR_0201  [0201]
R24076  10K  RESISTOR_0201  [0201]
R24077  10K  RESISTOR_0201  [0201]
R24078  10K  RESISTOR_0201  [0201]
R24079  10K  RESISTOR_0201  [0201]
R24080  10K  RESISTOR_0201  [0201]
R24081  10K  RESISTOR_0201  [0201]
R24082  10K  RESISTOR_0201  [0201]
R24083  10K  RESISTOR_0201  [0201]
R24084  10K  RESISTOR_0201  [0201]
R24085  10K  RESISTOR_0201  [0201]
R24086  10K  RESISTOR_0201  [0201]
R24087  10K  RESISTOR_0201  [0201]
R24088  10K  RESISTOR_0201  [0201]
R24089  10K  RESISTOR_0201  [0201]
R24090  10K  RESISTOR_0201  [0201]
R24091  10K  RESISTOR_0201  [0201]
R24092  10K  RESISTOR_0201  [0201]
R24093  10K  RESISTOR_0201  [0201]
R24094  10K  RESISTOR_0201  [0201]
R24095  10K  RESISTOR_0201  [0201]
R24096  10K  RESISTOR_0201  [0201]
R24097  10K  RESISTOR_0201  [0201]
R24098  10K  RESISTOR_0201  [0201]
R24099  10K  RESISTOR_0201  [0201]
R24100  10K  RESISTOR_0201  [0201]
R24101  10K  RESISTOR_0201  [0201]
R24102  10K  RESISTOR_0201  [0201]
R24103  10K  RESISTOR_0201  [0201]
R24104  10K  RESISTOR_0201  [0201]
R24105  10K  RESISTOR_0201  [0201]
R24106  10K  RESISTOR_0201  [0201]
R24107  10K  RESISTOR_0201  [0201]
R24108  10K  RESISTOR_0201  [0201]
R24109  10K  RESISTOR_0201  [0201]
R24110  10K  RESISTOR_0201  [0201]
R24111  10K  RESISTOR_0201  [0201]
R24112  10K  RESISTOR_0201  [0201]
R24113  10K  RESISTOR_0201  [0201]
R24114  10K  RESISTOR_0201  [0201]
R24115  10K  RESISTOR_0201  [0201]
R24116  10K  RESISTOR_0201  [0201]
R24117  10K  RESISTOR_0201  [0201]
R24118  10K  RESISTOR_0201  [0201]
R24119  10K  RESISTOR_0201  [0201]
R24120  10K  RESISTOR_0201  [0201]
R24121  10K  RESISTOR_0201  [0201]
R24122  10K  RESISTOR_0201  [0201]
R24123  10K  RESISTOR_0201  [0201]
R24124  10K  RESISTOR_0201  [0201]
R24125  10K  RESISTOR_0201  [0201]
R24126  10K  RESISTOR_0201  [0201]
R24127  10K  RESISTOR_0201  [0201]
R24128  10K  RESISTOR_0201  [0201]
R24129  10K  RESISTOR_0201  [0201]
R24130  10K  RESISTOR_0201  [0201]
R24131  10K  RESISTOR_0201  [0201]
R24132  10K  RESISTOR_0201  [0201]
R24133  10K  RESISTOR_0201  [0201]
R24134  10K  RESISTOR_0201  [0201]
R24135  10K  RESISTOR_0201  [0201]
R24136  10K  RESISTOR_0201  [0201]
R24137  10K  RESISTOR_0201  [0201]
R24138  10K  RESISTOR_0201  [0201]
R24139  10K  RESISTOR_0201  [0201]
R24140  10K  RESISTOR_0201  [0201]
R24141  10K  RESISTOR_0201  [0201]
R24142  10K  RESISTOR_0201  [0201]
R24143  10K  RESISTOR_0201  [0201]
R24144  10K  RESISTOR_0201  [0201]
R24145  10K  RESISTOR_0201  [0201]
R24146  10K  RESISTOR_0201  [0201]
R24147  10K  RESISTOR_0201  [0201]
R24148  10K  RESISTOR_0201  [0201]
R24149  10K  RESISTOR_0201  [0201]
R24150  10K  RESISTOR_0201  [0201]
R24151  10K  RESISTOR_0201  [0201]
R24152  10K  RESISTOR_0201  [0201]
R24153  10K  RESISTOR_0201  [0201]
R24154  10K  RESISTOR_0201  [0201]
R24155  10K  RESISTOR_0201  [0201]
R24156  10K  RESISTOR_0201  [0201]
R24157  10K  RESISTOR_0201  [0201]
R24158  10K  RESISTOR_0201  [0201]
R24159  10K  RESISTOR_0201  [0201]
R24160  10K  RESISTOR_0201  [0201]
R24161  10K  RESISTOR_0201  [0201]
R24162  10K  RESISTOR_0201  [0201]
R24163  10K  RESISTOR_0201  [0201]
R24164  10K  RESISTOR_0201  [0201]
R24165  10K  RESISTOR_0201  [0201]
R24166  10K  RESISTOR_0201  [0201]
R24167  10K  RESISTOR_0201  [0201]
R24168  10K  RESISTOR_0201  [0201]
R24169  10K  RESISTOR_0201  [0201]
R24170  10K  RESISTOR_0201  [0201]
R24171  10K  RESISTOR_0201  [0201]
R24172  10K  RESISTOR_0201  [0201]
R24173  10K  RESISTOR_0201  [0201]
R24174  10K  RESISTOR_0201  [0201]
R24175  10K  RESISTOR_0201  [0201]
R24176  10K  RESISTOR_0201  [0201]
R24177  10K  RESISTOR_0201  [0201]
R24178  10K  RESISTOR_0201  [0201]
R24179  10K  RESISTOR_0201  [0201]
R24180  10K  RESISTOR_0201  [0201]
R24181  10K  RESISTOR_0201  [0201]
R24182  10K  RESISTOR_0201  [0201]
R24183  10K  RESISTOR_0201  [0201]
R24184  10K  RESISTOR_0201  [0201]
R24185  10K  RESISTOR_0201  [0201]
R24186  10K  RESISTOR_0201  [0201]
R24187  10K  RESISTOR_0201  [0201]
R24188  10K  RESISTOR_0201  [0201]
R24189  10K  RESISTOR_0201  [0201]
R24190  10K  RESISTOR_0201  [0201]
R24191  10K  RESISTOR_0201  [0201]
R24192  10K  RESISTOR_0201  [0201]
R24193  10K  RESISTOR_0201  [0201]
R24194  10K  RESISTOR_0201  [0201]
R24195  10K  RESISTOR_0201  [0201]
R24196  10K  RESISTOR_0201  [0201]
R24197  10K  RESISTOR_0201  [0201]
R24198  10K  RESISTOR_0201  [0201]
R24199  10K  RESISTOR_0201  [0201]
R24200  10K  RESISTOR_0201  [0201]
R24201  10K  RESISTOR_0201  [0201]
R24202  10K  RESISTOR_0201  [0201]
R24203  10K  RESISTOR_0201  [0201]
R24204  10K  RESISTOR_0201  [0201]
R24205  10K  RESISTOR_0201  [0201]
R24206  10K  RESISTOR_0201  [0201]
R24207  10K  RESISTOR_0201  [0201]
R24208  10K  RESISTOR_0201  [0201]
R24209  10K  RESISTOR_0201  [0201]
R24210  10K  RESISTOR_0201  [0201]
R24211  10K  RESISTOR_0201  [0201]
R24212  10K  RESISTOR_0201  [0201]
R24213  10K  RESISTOR_0201  [0201]
R24214  10K  RESISTOR_0201  [0201]
R24215  10K  RESISTOR_0201  [0201]
R24216  10K  RESISTOR_0201  [0201]
R24217  10K  RESISTOR_0201  [0201]
R24218  10K  RESISTOR_0201  [0201]
R24219  10K  RESISTOR_0201  [0201]
R24220  10K  RESISTOR_0201  [0201]
R24221  10K  RESISTOR_0201  [0201]
R24222  10K  RESISTOR_0201  [0201]
R24223  10K  RESISTOR_0201  [0201]
R24224  10K  RESISTOR_0201  [0201]
R24225  10K  RESISTOR_0201  [0201]
R24226  10K  RESISTOR_0201  [0201]
R24227  10K  RESISTOR_0201  [0201]
R24228  10K  RESISTOR_0201  [0201]
R24229  10K  RESISTOR_0201  [0201]
R24230  10K  RESISTOR_0201  [0201]
R24231  10K  RESISTOR_0201  [0201]
R24232  10K  RESISTOR_0201  [0201]
R24233  10K  RESISTOR_0201  [0201]
R24234  10K  RESISTOR_0201  [0201]
R24235  10K  RESISTOR_0201  [0201]
R24236  10K  RESISTOR_0201  [0201]
R24237  10K  RESISTOR_0201  [0201]
R24238  10K  RESISTOR_0201  [0201]
R24239  10K  RESISTOR_0201  [0201]
R24240  10K  RESISTOR_0201  [0201]
R24241  10K  RESISTOR_0201  [0201]
R24242  10K  RESISTOR_0201  [0201]
R24243  10K  RESISTOR_0201  [0201]
R24244  10K  RESISTOR_0201  [0201]
R24245  10K  RESISTOR_0201  [0201]
R24246  10K  RESISTOR_0201  [0201]
R24247  10K  RESISTOR_0201  [0201]
R24248  10K  RESISTOR_0201  [0201]
R24249  10K  RESISTOR_0201  [0201]
R24250  10K  RESISTOR_0201  [0201]
R24251  10K  RESISTOR_0201  [0201]
R24252  10K  RESISTOR_0201  [0201]
R24253  10K  RESISTOR_0201  [0201]
R24254  10K  RESISTOR_0201  [0201]
R24255  10K  RESISTOR_0201  [0201]
R24256  10K  RESISTOR_0201  [0201]
R24257  10K  RESISTOR_0201  [0201]
R24258  10K  RESISTOR_0201  [0201]
R24259  10K  RESISTOR_0201  [0201]
R24260  10K  RESISTOR_0201  [0201]
R24261  10K  RESISTOR_0201  [0201]
R24262  10K  RESISTOR_0201  [0201]
R24263  10K  RESISTOR_0201  [0201]
R24264  10K  RESISTOR_0201  [0201]
R24265  10K  RESISTOR_0201  [0201]
R24266  10K  RESISTOR_0201  [0201]
R24267  10K  RESISTOR_0201  [0201]
R24268  10K  RESISTOR_0201  [0201]
R24269  10K  RESISTOR_0201  [0201]
R24270  10K  RESISTOR_0201  [0201]
R24271  10K  RESISTOR_0201  [0201]
R24272  10K  RESISTOR_0201  [0201]
R24273  10K  RESISTOR_0201  [0201]
R24274  10K  RESISTOR_0201  [0201]
R24275  10K  RESISTOR_0201  [0201]
R24276  10K  RESISTOR_0201  [0201]
R24277  10K  RESISTOR_0201  [0201]
R24278  10K  RESISTOR_0201  [0201]
R24279  10K  RESISTOR_0201  [0201]
R24280  10K  RESISTOR_0201  [0201]
R24281  10K  RESISTOR_0201  [0201]
R24282  10K  RESISTOR_0201  [0201]
R24283  10K  RESISTOR_0201  [0201]
R24284  10K  RESISTOR_0201  [0201]
R24285  10K  RESISTOR_0201  [0201]
R24286  10K  RESISTOR_0201  [0201]
R24287  10K  RESISTOR_0201  [0201]
R24288  10K  RESISTOR_0201  [0201]
R24289  10K  RESISTOR_0201  [0201]
R24290  10K  RESISTOR_0201  [0201]
R24291  10K  RESISTOR_0201  [0201]
R24292  10K  RESISTOR_0201  [0201]
R24293  10K  RESISTOR_0201  [0201]
R24294  10K  RESISTOR_0201  [0201]
R24295  10K  RESISTOR_0201  [0201]
R24296  10K  RESISTOR_0201  [0201]
R24297  10K  RESISTOR_0201  [0201]
R24298  10K  RESISTOR_0201  [0201]
R24299  10K  RESISTOR_0201  [0201]
R24300  10K  RESISTOR_0201  [0201]
R24301  10K  RESISTOR_0201  [0201]
R24302  10K  RESISTOR_0201  [0201]
R24303  10K  RESISTOR_0201  [0201]
R24304  10K  RESISTOR_0201  [0201]
R24305  10K  RESISTOR_0201  [0201]
R24306  10K  RESISTOR_0201  [0201]
R24307  10K  RESISTOR_0201  [0201]
R24308  10K  RESISTOR_0201  [0201]
R24309  10K  RESISTOR_0201  [0201]
R24310  10K  RESISTOR_0201  [0201]
R24311  10K  RESISTOR_0201  [0201]
R24312  10K  RESISTOR_0201  [0201]
R24313  10K  RESISTOR_0201  [0201]
R24314  10K  RESISTOR_0201  [0201]
R24315  10K  RESISTOR_0201  [0201]
R24316  10K  RESISTOR_0201  [0201]
R24317  10K  RESISTOR_0201  [0201]
R24318  10K  RESISTOR_0201  [0201]
R24319  10K  RESISTOR_0201  [0201]
R24320  10K  RESISTOR_0201  [0201]
R24321  10K  RESISTOR_0201  [0201]
R24322  10K  RESISTOR_0201  [0201]
R24323  10K  RESISTOR_0201  [0201]
R24324  10K  RESISTOR_0201  [0201]
R24325  10K  RESISTOR_0201  [0201]
R24326  10K  RESISTOR_0201  [0201]
R24327  10K  RESISTOR_0201  [0201]
R24328  10K  RESISTOR_0201  [0201]
R24329  10K  RESISTOR_0201  [0201]
R24330  10K  RESISTOR_0201  [0201]
R24331  10K  RESISTOR_0201  [0201]
R24332  10K  RESISTOR_0201  [0201]
R24333  10K  RESISTOR_0201  [0201]
R24334  10K  RESISTOR_0201  [0201]
R24335  10K  RESISTOR_0201  [0201]
R24336  10K  RESISTOR_0201  [0201]
R24337  10K  RESISTOR_0201  [0201]
R24338  10K  RESISTOR_0201  [0201]
R24339  10K  RESISTOR_0201  [0201]
R24340  10K  RESISTOR_0201  [0201]
R24341  10K  RESISTOR_0201  [0201]
R24342  10K  RESISTOR_0201  [0201]
R24343  10K  RESISTOR_0201  [0201]
R24344  10K  RESISTOR_0201  [0201]
R24345  10K  RESISTOR_0201  [0201]
R24346  10K  RESISTOR_0201  [0201]
R24347  10K  RESISTOR_0201  [0201]
R24348  10K  RESISTOR_0201  [0201]
R24349  10K  RESISTOR_0201  [0201]
R24350  10K  RESISTOR_0201  [0201]
R24351  10K  RESISTOR_0201  [0201]
R24352  10K  RESISTOR_0201  [0201]
R24353  10K  RESISTOR_0201  [0201]
R24354  10K  RESISTOR_0201  [0201]
R24355  10K  RESISTOR_0201  [0201]
R24356  10K  RESISTOR_0201  [0201]
R24357  10K  RESISTOR_0201  [0201]
R24358  10K  RESISTOR_0201  [0201]
R24359  10K  RESISTOR_0201  [0201]
R24360  10K  RESISTOR_0201  [0201]
R24361  10K  RESISTOR_0201  [0201]
R24362  10K  RESISTOR_0201  [0201]
R24363  10K  RESISTOR_0201  [0201]
R24364  10K  RESISTOR_0201  [0201]
R24365  10K  RESISTOR_0201  [0201]
R24366  10K  RESISTOR_0201  [0201]
R24367  10K  RESISTOR_0201  [0201]
R24368  10K  RESISTOR_0201  [0201]
R24369  10K  RESISTOR_0201  [0201]
R24370  10K  RESISTOR_0201  [0201]
R24371  10K  RESISTOR_0201  [0201]
R24372  10K  RESISTOR_0201  [0201]
R24373  10K  RESISTOR_0201  [0201]
R24374  10K  RESISTOR_0201  [0201]
R24375  10K  RESISTOR_0201  [0201]
R24376  10K  RESISTOR_0201  [0201]
R24377  10K  RESISTOR_0201  [0201]
R24378  10K  RESISTOR_0201  [0201]
R24379  10K  RESISTOR_0201  [0201]
R24380  10K  RESISTOR_0201  [0201]
R24381  10K  RESISTOR_0201  [0201]
R24382  10K  RESISTOR_0201  [0201]
R24383  10K  RESISTOR_0201  [0201]
R24384  10K  RESISTOR_0201  [0201]
R24385  10K  RESISTOR_0201  [0201]
R24386  10K  RESISTOR_0201  [0201]
R24387  10K  RESISTOR_0201  [0201]
R24388  10K  RESISTOR_0201  [0201]
R24389  10K  RESISTOR_0201  [0201]
R24390  10K  RESISTOR_0201  [0201]
R24391  10K  RESISTOR_0201  [0201]
R24392  10K  RESISTOR_0201  [0201]
R24393  10K  RESISTOR_0201  [0201]
R24394  10K  RESISTOR_0201  [0201]
R24395  10K  RESISTOR_0201  [0201]
R24396  10K  RESISTOR_0201  [0201]
R24397  10K  RESISTOR_0201  [0201]
R24398  10K  RESISTOR_0201  [0201]
R24399  10K  RESISTOR_0201  [0201]
R24400  10K  RESISTOR_0201  [0201]
R24401  10K  RESISTOR_0201  [0201]
R24402  10K  RESISTOR_0201  [0201]
R24403  10K  RESISTOR_0201  [0201]
R24404  10K  RESISTOR_0201  [0201]
R24405  10K  RESISTOR_0201  [0201]
R24406  10K  RESISTOR_0201  [0201]
R24407  10K  RESISTOR_0201  [0201]
R24408  10K  RESISTOR_0201  [0201]
R24409  10K  RESISTOR_0201  [0201]
R24410  10K  RESISTOR_0201  [0201]
R24411  10K  RESISTOR_0201  [0201]
R24412  10K  RESISTOR_0201  [0201]
R24413  10K  RESISTOR_0201  [0201]
R24414  10K  RESISTOR_0201  [0201]
R24415  10K  RESISTOR_0201  [0201]
R24416  10K  RESISTOR_0201  [0201]
R24417  10K  RESISTOR_0201  [0201]
R24418  10K  RESISTOR_0201  [0201]
R24419  10K  RESISTOR_0201  [0201]
R24420  10K  RESISTOR_0201  [0201]
R24421  10K  RESISTOR_0201  [0201]
R24422  10K  RESISTOR_0201  [0201]
R24423  10K  RESISTOR_0201  [0201]
R24424  10K  RESISTOR_0201  [0201]
R24425  10K  RESISTOR_0201  [0201]
R24426  10K  RESISTOR_0201  [0201]
R24427  10K  RESISTOR_0201  [0201]
R24428  10K  RESISTOR_0201  [0201]
R24429  10K  RESISTOR_0201  [0201]
R24430  10K  RESISTOR_0201  [0201]
R24431  10K  RESISTOR_0201  [0201]
R24432  10K  RESISTOR_0201  [0201]
R24433  10K  RESISTOR_0201  [0201]
R24434  10K  RESISTOR_0201  [0201]
R24435  10K  RESISTOR_0201  [0201]
R24436  10K  RESISTOR_0201  [0201]
R24437  10K  RESISTOR_0201  [0201]